# EasyEDA Pro project kuafu01_030内部老化方案.eprj, board PCB4 (continued)
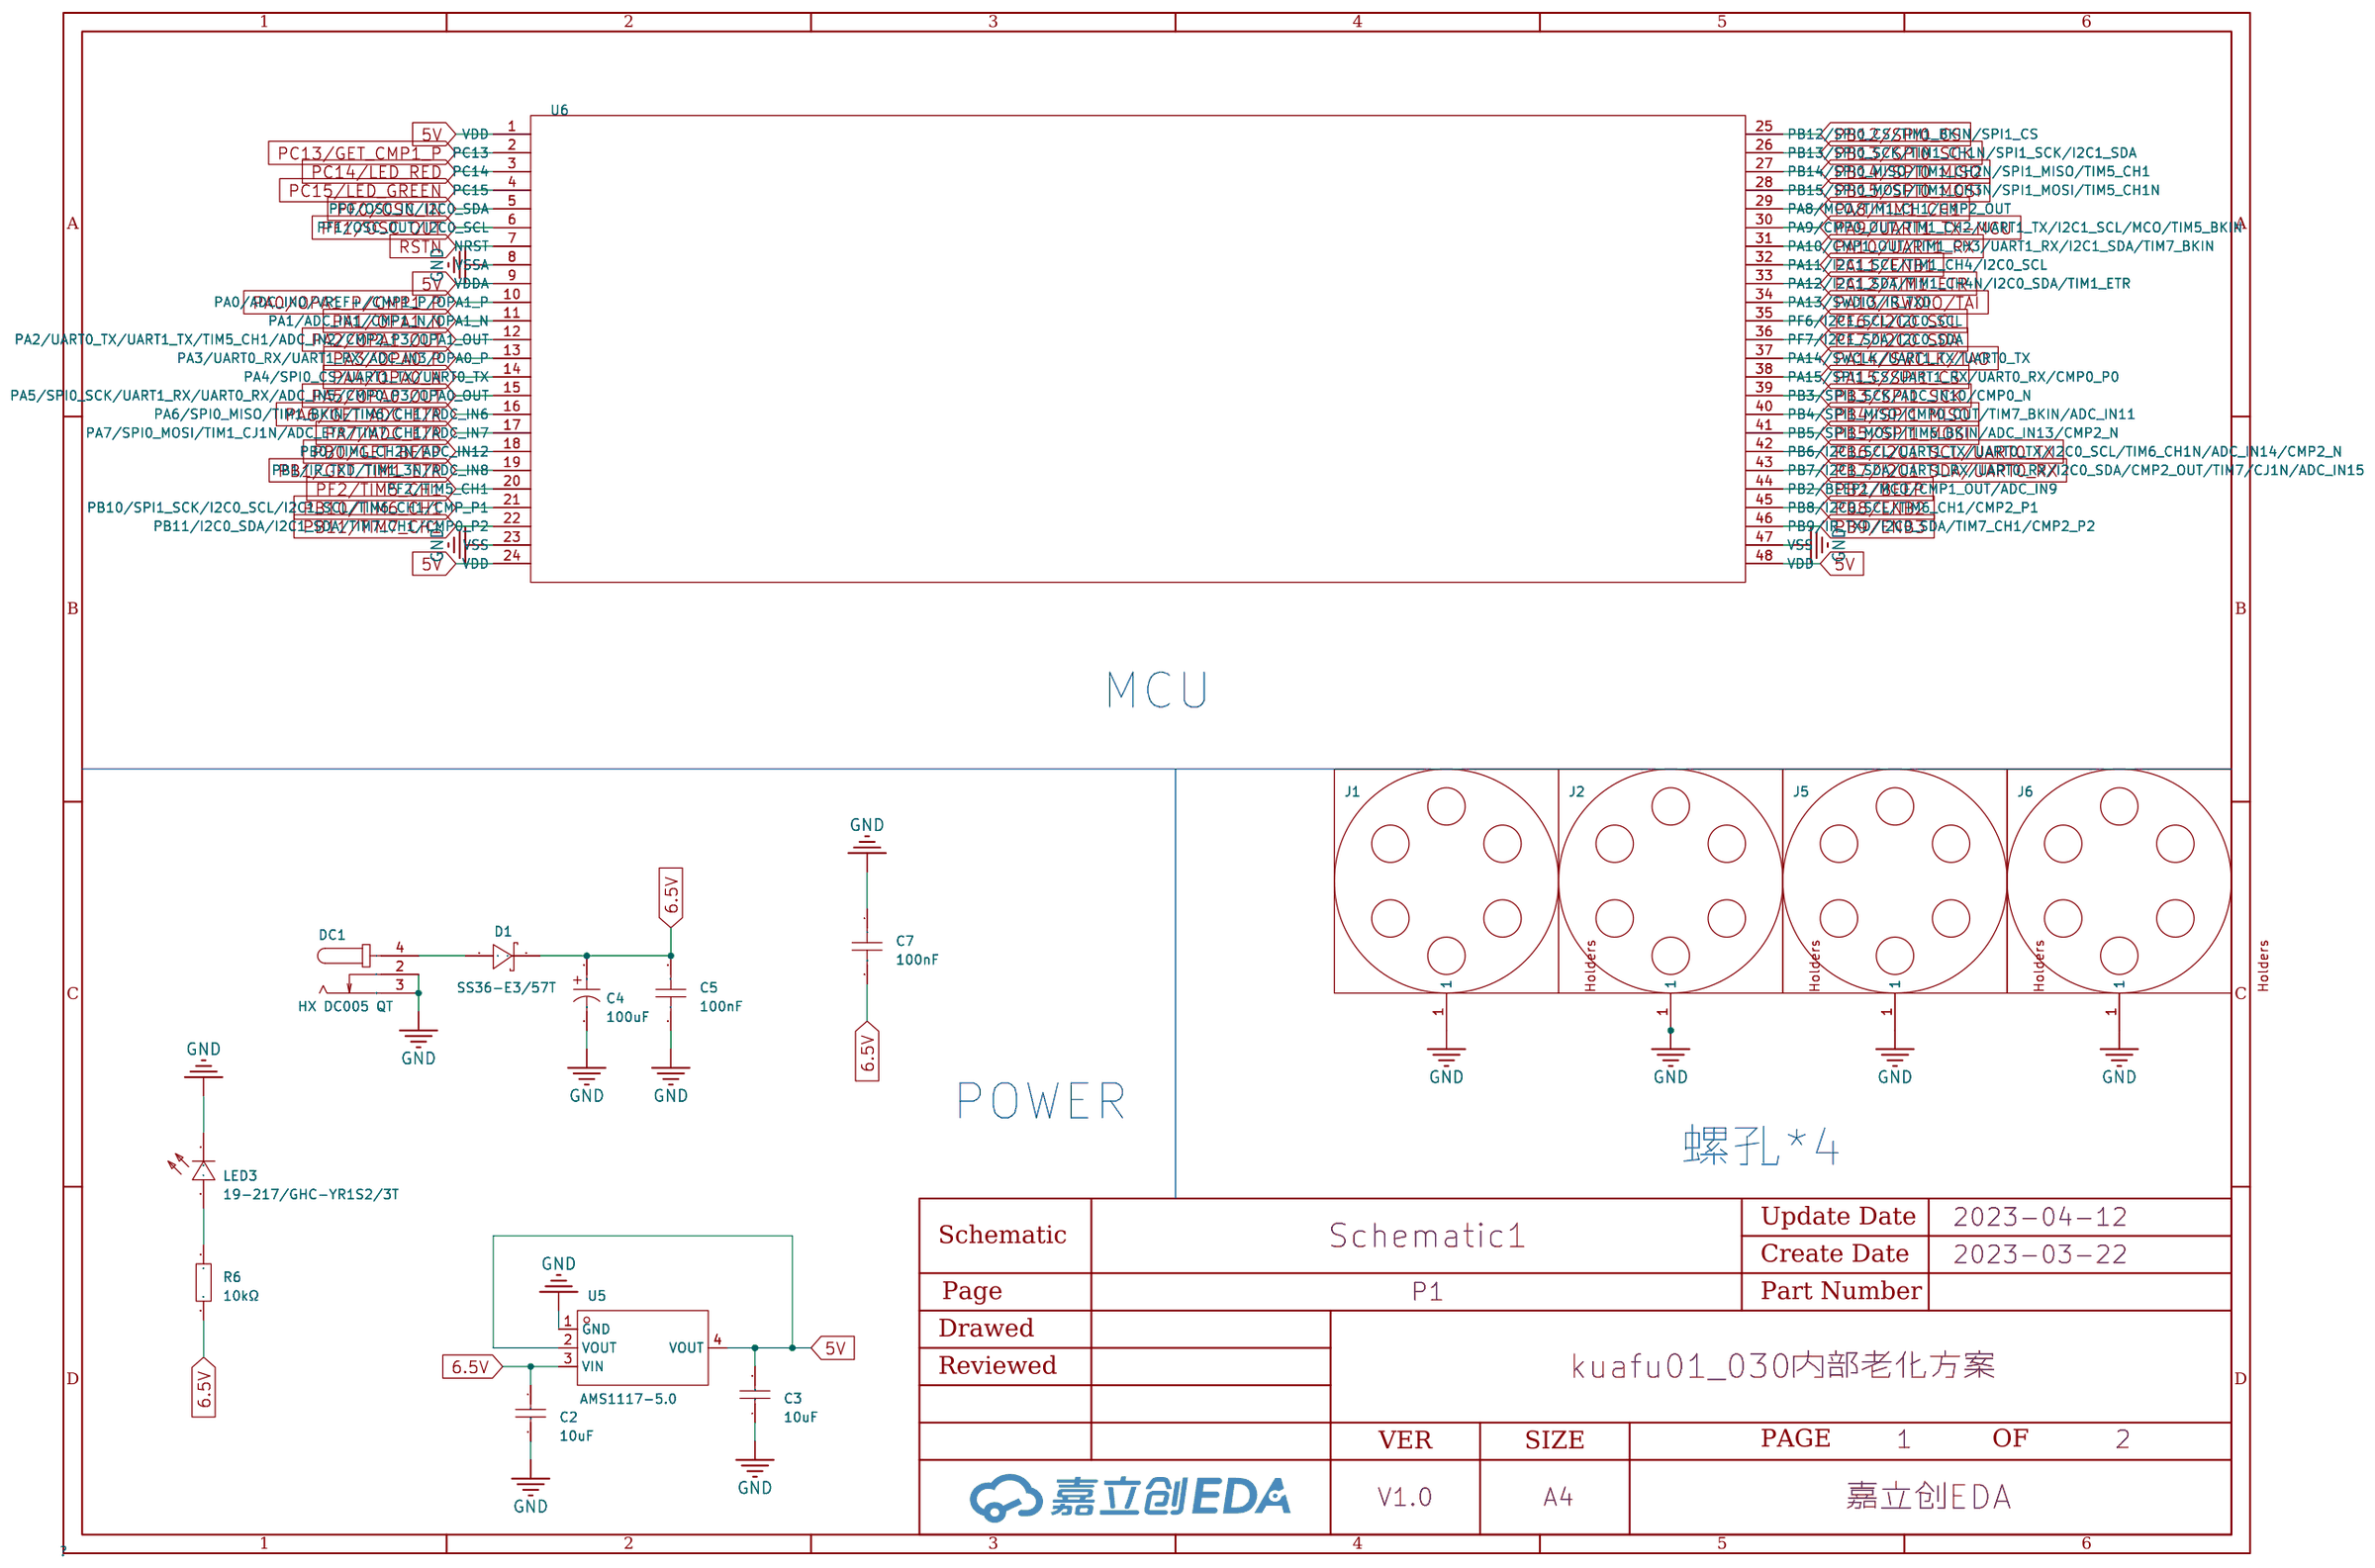
[diagram p0: P1]
## Routing (per net, layer and track width the routed paths; a pad name or vN(x,y) marks a point on that pad's centre or on a via; arc(x,y) is an arc through that point) (continued)
v1(170.94,68.83) v1(170.94,68.07) v1(170.94,41.15) v1(170.94,40.39) v1(170.94,39.62) v1(170.94,18.8) v1(170.94,18.03) v1(170.94,17.27) v1(171.7,345.95) v1(171.7,345.19) v1(171.7,344.42) v1(171.7,323.6) v1(171.7,322.83) v1(171.7,322.07) v1(171.7,295.15) v1(171.7,294.39) v1(171.7,293.62) v1(171.7,272.8) v1(171.7,272.03) v1(171.7,271.27) v1(171.7,244.35) v1(171.7,243.59) v1(171.7,242.82) v1(171.7,222) v1(171.7,221.23) v1(171.7,220.47) v1(171.7,193.55) v1(171.7,192.79) v1(171.7,192.02) v1(171.7,171.2) v1(171.7,170.43) v1(171.7,169.67) v1(171.7,142.75) v1(171.7,141.99) v1(171.7,141.22) v1(171.7,120.4) v1(171.7,119.63) v1(171.7,118.87) v1(171.7,91.95) v1(171.7,91.19) v1(171.7,90.42) v1(171.7,69.6) v1(171.7,68.83) v1(171.7,68.07) v1(171.7,41.15) v1(171.7,40.39) v1(171.7,39.62) v1(171.7,18.8) v1(171.7,18.03) v1(171.7,17.27) v1(173.23,338.84) v1(173.23,338.07) v1(173.23,337.31) v1(173.23,329.18) v1(173.23,328.42) v1(173.23,327.66) v1(173.23,288.04) v1(173.23,287.27) v1(173.23,286.51) v1(173.23,278.38) v1(173.23,277.62) v1(173.23,276.86) v1(173.23,237.24) v1(173.23,236.47) v1(173.23,235.71) v1(173.23,227.58) v1(173.23,226.82) v1(173.23,226.06) v1(173.23,186.44) v1(173.23,185.67) v1(173.23,184.91) v1(173.23,176.78) v1(173.23,176.02) v1(173.23,175.26) v1(173.23,135.64) v1(173.23,134.87) v1(173.23,134.11) v1(173.23,125.98) v1(173.23,125.22) v1(173.23,124.46) v1(173.23,84.84) v1(173.23,84.07) v1(173.23,83.31) v1(173.23,75.18) v1(173.23,74.42) v1(173.23,73.66) v1(173.23,34.04) v1(173.23,33.27) v1(173.23,32.51) v1(173.23,24.38) v1(173.23,23.62) v1(173.23,22.86) v1(173.99,338.84) v1(173.99,338.07) v1(173.99,337.31) v1(173.99,329.18) v1(173.99,328.42) v1(173.99,327.66) v1(173.99,288.04) v1(173.99,287.27) v1(173.99,286.51) v1(173.99,278.38) v1(173.99,277.62) v1(173.99,276.86) v1(173.99,237.24) v1(173.99,236.47) v1(173.99,235.71) v1(173.99,227.58) v1(173.99,226.82) v1(173.99,226.06) v1(173.99,186.44) v1(173.99,185.67) v1(173.99,184.91) v1(173.99,176.78) v1(173.99,176.02) v1(173.99,175.26) v1(173.99,135.64) v1(173.99,134.87) v1(173.99,134.11) v1(173.99,125.98) v1(173.99,125.22) v1(173.99,124.46) v1(173.99,84.84) v1(173.99,84.07) v1(173.99,83.31) v1(173.99,75.18) v1(173.99,74.42) v1(173.99,73.66) v1(173.99,34.04) v1(173.99,33.27) v1(173.99,32.51) v1(173.99,24.38) v1(173.99,23.62) v1(173.99,22.86) v1(174.75,338.84) v1(174.75,338.07) v1(174.75,337.31) v1(174.75,329.18) v1(174.75,328.42) v1(174.75,327.66) v1(174.75,288.04) v1(174.75,287.27) v1(174.75,286.51) v1(174.75,278.38) v1(174.75,277.62) v1(174.75,276.86) v1(174.75,237.24) v1(174.75,236.47) v1(174.75,235.71) v1(174.75,227.58) v1(174.75,226.82) v1(174.75,226.06) v1(174.75,186.44) v1(174.75,185.67) v1(174.75,184.91) v1(174.75,176.78) v1(174.75,176.02) v1(174.75,175.26) v1(174.75,135.64) v1(174.75,134.87) v1(174.75,134.11) v1(174.75,125.98) v1(174.75,125.22) v1(174.75,124.46) v1(174.75,84.84) v1(174.75,84.07) v1(174.75,83.31) v1(174.75,75.18) v1(174.75,74.42) v1(174.75,73.66) v1(174.75,34.04) v1(174.75,33.27) v1(174.75,32.51) v1(174.75,24.38) v1(174.75,23.62) v1(174.75,22.86) v1(179.83,338.84) v1(179.83,338.07) v1(179.83,337.31) v1(179.83,332.74) v1(179.83,331.98) v1(179.83,331.22) v1(179.83,325.12) v1(179.83,324.36) v1(179.83,323.6) v1(179.83,288.04) v1(179.83,287.27) v1(179.83,286.51) v1(179.83,281.94) v1(179.83,281.18) v1(179.83,280.42) v1(179.83,274.32) v1(179.83,273.56) v1(179.83,272.8) v1(179.83,237.24) v1(179.83,236.47) v1(179.83,235.71) v1(179.83,231.14) v1(179.83,230.38) v1(179.83,229.62) v1(179.83,223.52) v1(179.83,222.76) v1(179.83,222) v1(179.83,186.44) v1(179.83,185.67) v1(179.83,184.91) v1(179.83,180.34) v1(179.83,179.58) v1(179.83,178.82) v1(179.83,172.72) v1(179.83,171.96) v1(179.83,171.2) v1(179.83,135.64) v1(179.83,134.87) v1(179.83,134.11) v1(179.83,129.54) v1(179.83,128.78) v1(179.83,128.02) v1(179.83,121.92) v1(179.83,121.16) v1(179.83,120.4) v1(179.83,84.84) v1(179.83,84.07) v1(179.83,83.31) v1(179.83,78.74) v1(179.83,77.98) v1(179.83,77.22) v1(179.83,71.12) v1(179.83,70.36) v1(179.83,69.6) v1(179.83,34.04) v1(179.83,33.27) v1(179.83,32.51) v1(179.83,27.94) v1(179.83,27.18) v1(179.83,26.42) v1(179.83,20.32) v1(179.83,19.56) v1(179.83,18.8) v1(180.59,338.84) v1(180.59,338.07) v1(180.59,337.31) v1(180.59,332.74) v1(180.59,331.98) v1(180.59,331.22) v1(180.59,325.12) v1(180.59,324.36) v1(180.59,323.6) v1(180.59,288.04) v1(180.59,287.27) v1(180.59,286.51) v1(180.59,281.94) v1(180.59,281.18) v1(180.59,280.42) v1(180.59,274.32) v1(180.59,273.56) v1(180.59,272.8) v1(180.59,237.24) v1(180.59,236.47) v1(180.59,235.71) v1(180.59,231.14) v1(180.59,230.38) v1(180.59,229.62) v1(180.59,223.52) v1(180.59,222.76) v1(180.59,222) v1(180.59,186.44) v1(180.59,185.67) v1(180.59,184.91) v1(180.59,180.34) v1(180.59,179.58) v1(180.59,178.82) v1(180.59,172.72) v1(180.59,171.96) v1(180.59,171.2) v1(180.59,135.64) v1(180.59,134.87) v1(180.59,134.11) v1(180.59,129.54) v1(180.59,128.78) v1(180.59,128.02) v1(180.59,121.92) v1(180.59,121.16) v1(180.59,120.4) v1(180.59,84.84) v1(180.59,84.07) v1(180.59,83.31) v1(180.59,78.74) v1(180.59,77.98) v1(180.59,77.22) v1(180.59,71.12) v1(180.59,70.36) v1(180.59,69.6) v1(180.59,34.04) v1(180.59,33.27) v1(180.59,32.51) v1(180.59,27.94) v1(180.59,27.18) v1(180.59,26.42) v1(180.59,20.32) v1(180.59,19.56) v1(180.59,18.8) v1(181.36,338.84) v1(181.36,338.07) v1(181.36,337.31) v1(181.36,332.74) v1(181.36,331.98) v1(181.36,331.22) v1(181.36,325.12) v1(181.36,324.36) v1(181.36,323.6) v1(181.36,288.04) v1(181.36,287.27) v1(181.36,286.51) v1(181.36,281.94) v1(181.36,281.18) v1(181.36,280.42) v1(181.36,274.32) v1(181.36,273.56) v1(181.36,272.8) v1(181.36,237.24) v1(181.36,236.47) v1(181.36,235.71) v1(181.36,231.14) v1(181.36,230.38) v1(181.36,229.62) v1(181.36,223.52) v1(181.36,222.76) v1(181.36,222) v1(181.36,186.44) v1(181.36,185.67) v1(181.36,184.91) v1(181.36,180.34) v1(181.36,179.58) v1(181.36,178.82) v1(181.36,172.72) v1(181.36,171.96) v1(181.36,171.2) v1(181.36,135.64) v1(181.36,134.87) v1(181.36,134.11) v1(181.36,129.54) v1(181.36,128.78) v1(181.36,128.02) v1(181.36,121.92) v1(181.36,121.16) v1(181.36,120.4) v1(181.36,84.84) v1(181.36,84.07) v1(181.36,83.31) v1(181.36,78.74) v1(181.36,77.98) v1(181.36,77.22) v1(181.36,71.12) v1(181.36,70.36) v1(181.36,69.6) v1(181.36,34.04) v1(181.36,33.27) v1(181.36,32.51) v1(181.36,27.94) v1(181.36,27.18) v1(181.36,26.42) v1(181.36,20.32) v1(181.36,19.56) v1(181.36,18.8) v1(181.86,345.95) v1(181.86,345.19) v1(181.86,344.42) v1(181.86,295.15) v1(181.86,294.39) v1(181.86,293.62) v1(181.86,244.35) v1(181.86,243.59) v1(181.86,242.82) v1(181.86,193.55) v1(181.86,192.79) v1(181.86,192.02) v1(181.86,142.75) v1(181.86,141.99) v1(181.86,141.22) v1(181.86,91.95) v1(181.86,91.19) v1(181.86,90.42) v1(181.86,41.15) v1(181.86,40.39) v1(181.86,39.62) v1(182.63,345.95) v1(182.63,345.19) v1(182.63,344.42) v1(182.63,295.15) v1(182.63,294.39) v1(182.63,293.62) v1(182.63,244.35) v1(182.63,243.59) v1(182.63,242.82) v1(182.63,193.55) v1(182.63,192.79) v1(182.63,192.02) v1(182.63,142.75) v1(182.63,141.99) v1(182.63,141.22) v1(182.63,91.95) v1(182.63,91.19) v1(182.63,90.42) v1(182.63,41.15) v1(182.63,40.39) v1(182.63,39.62) v1(183.39,352.04) v1(183.39,351.28) v1(183.39,350.52) v1(183.39,345.95) v1(183.39,345.19) v1(183.39,344.42) v1(183.39,301.24) v1(183.39,300.48) v1(183.39,299.72) v1(183.39,295.15) v1(183.39,294.39) v1(183.39,293.62) v1(183.39,250.44) v1(183.39,249.68) v1(183.39,248.92) v1(183.39,244.35) v1(183.39,243.59) v1(183.39,242.82) v1(183.39,199.64) v1(183.39,198.88) v1(183.39,198.12) v1(183.39,193.55) v1(183.39,192.79) v1(183.39,192.02) v1(183.39,148.84) v1(183.39,148.08) v1(183.39,147.32) v1(183.39,142.75) v1(183.39,141.99) v1(183.39,141.22) v1(183.39,98.04) v1(183.39,97.28) v1(183.39,96.52) v1(183.39,91.95) v1(183.39,91.19) v1(183.39,90.42) v1(183.39,47.24) v1(183.39,46.48) v1(183.39,45.72) v1(183.39,41.15) v1(183.39,40.39) v1(183.39,39.62) v1(184.15,352.04) v1(184.15,351.28) v1(184.15,350.52) v1(184.15,301.24) v1(184.15,300.48) v1(184.15,299.72) v1(184.15,250.44) v1(184.15,249.68) v1(184.15,248.92) v1(184.15,199.64) v1(184.15,198.88) v1(184.15,198.12) v1(184.15,148.84) v1(184.15,148.08) v1(184.15,147.32) v1(184.15,98.04) v1(184.15,97.28) v1(184.15,96.52) v1(184.15,47.24) v1(184.15,46.48) v1(184.15,45.72) v1(184.91,352.04) v1(184.91,351.28) v1(184.91,350.52) v1(184.91,301.24) v1(184.91,300.48) v1(184.91,299.72) v1(184.91,250.44) v1(184.91,249.68) v1(184.91,248.92) v1(184.91,199.64) v1(184.91,198.88) v1(184.91,198.12) v1(184.91,148.84) v1(184.91,148.08) v1(184.91,147.32) v1(184.91,98.04) v1(184.91,97.28) v1(184.91,96.52) v1(184.91,47.24) v1(184.91,46.48) v1(184.91,45.72) v1(185.42,358.14) v1(185.42,357.38) v1(185.42,356.62) v1(185.42,319.02) v1(185.42,318.26) v1(185.42,317.5) v1(185.42,307.34) v1(185.42,306.58) v1(185.42,305.82) v1(185.42,268.22) v1(185.42,267.46) v1(185.42,266.7) v1(185.42,256.54) v1(185.42,255.78) v1(185.42,255.02) v1(185.42,217.42) v1(185.42,216.66) v1(185.42,215.9) v1(185.42,205.74) v1(185.42,204.98) v1(185.42,204.22) v1(185.42,166.62) v1(185.42,165.86) v1(185.42,165.1) v1(185.42,154.94) v1(185.42,154.18) v1(185.42,153.42) v1(185.42,115.82) v1(185.42,115.06) v1(185.42,114.3) v1(185.42,104.14) v1(185.42,103.38) v1(185.42,102.62) v1(185.42,65.02) v1(185.42,64.26) v1(185.42,63.5) v1(185.42,53.34) v1(185.42,52.58) v1(185.42,51.82) v1(185.42,14.22) v1(185.42,13.46) v1(185.42,12.7) v1(186.18,358.14) v1(186.18,357.38) v1(186.18,356.62) v1(186.18,319.02) v1(186.18,318.26) v1(186.18,317.5) v1(186.18,307.34) v1(186.18,306.58) v1(186.18,305.82) v1(186.18,268.22) v1(186.18,267.46) v1(186.18,266.7) v1(186.18,256.54) v1(186.18,255.78) v1(186.18,255.02) v1(186.18,217.42) v1(186.18,216.66) v1(186.18,215.9) v1(186.18,205.74) v1(186.18,204.98) v1(186.18,204.22) v1(186.18,166.62) v1(186.18,165.86) v1(186.18,165.1) v1(186.18,154.94) v1(186.18,154.18) v1(186.18,153.42) v1(186.18,115.82) v1(186.18,115.06) v1(186.18,114.3) v1(186.18,104.14) v1(186.18,103.38) v1(186.18,102.62) v1(186.18,65.02) v1(186.18,64.26) v1(186.18,63.5) v1(186.18,53.34) v1(186.18,52.58) v1(186.18,51.82) v1(186.18,14.22) v1(186.18,13.46) v1(186.18,12.7) v1(186.94,358.14) v1(186.94,357.38) v1(186.94,356.62) v1(186.94,319.02) v1(186.94,318.26) v1(186.94,317.5) v1(186.94,307.34) v1(186.94,306.58) v1(186.94,305.82) v1(186.94,268.22) v1(186.94,267.46) v1(186.94,266.7) v1(186.94,256.54) v1(186.94,255.78) v1(186.94,255.02) v1(186.94,217.42) v1(186.94,216.66) v1(186.94,215.9) v1(186.94,205.74) v1(186.94,204.98) v1(186.94,204.22) v1(186.94,166.62) v1(186.94,165.86) v1(186.94,165.1) v1(186.94,154.94) v1(186.94,154.18) v1(186.94,153.42) v1(186.94,115.82) v1(186.94,115.06) v1(186.94,114.3) v1(186.94,104.14) v1(186.94,103.38) v1(186.94,102.62) v1(186.94,65.02) v1(186.94,64.26) v1(186.94,63.5) v1(186.94,53.34) v1(186.94,52.58) v1(186.94,51.82) v1(186.94,14.22) v1(186.94,13.46) v1(186.94,12.7) v1(215.39,358.14) v1(215.39,357.38) v1(215.39,356.62) v1(215.39,319.02) v1(215.39,318.26) v1(215.39,317.5) v1(215.39,307.34) v1(215.39,306.58) v1(215.39,305.82) v1(215.39,268.22) v1(215.39,267.46) v1(215.39,266.7) v1(215.39,256.54) v1(215.39,255.78) v1(215.39,255.02) v1(215.39,217.42) v1(215.39,216.66) v1(215.39,215.9) v1(215.39,205.74) v1(215.39,204.98) v1(215.39,204.22) v1(215.39,166.62) v1(215.39,165.86) v1(215.39,165.1) v1(215.39,154.94) v1(215.39,154.18) v1(215.39,153.42) v1(215.39,115.82) v1(215.39,115.06) v1(215.39,114.3) v1(215.39,104.14) v1(215.39,103.38) v1(215.39,102.62) v1(215.39,65.02) v1(215.39,64.26) v1(215.39,63.5) v1(215.39,53.34) v1(215.39,52.58) v1(215.39,51.82) v1(215.39,14.22) v1(215.39,13.46) v1(215.39,12.7) v1(216.15,358.14) v1(216.15,357.38) v1(216.15,356.62) v1(216.15,319.02) v1(216.15,318.26) v1(216.15,317.5) v1(216.15,307.34) v1(216.15,306.58) v1(216.15,305.82) v1(216.15,268.22) v1(216.15,267.46) v1(216.15,266.7) v1(216.15,256.54) v1(216.15,255.78) v1(216.15,255.02) v1(216.15,217.42) v1(216.15,216.66) v1(216.15,215.9) v1(216.15,205.74) v1(216.15,204.98) v1(216.15,204.22) v1(216.15,166.62) v1(216.15,165.86) v1(216.15,165.1) v1(216.15,154.94) v1(216.15,154.18) v1(216.15,153.42) v1(216.15,115.82) v1(216.15,115.06) v1(216.15,114.3) v1(216.15,104.14) v1(216.15,103.38) v1(216.15,102.62) v1(216.15,65.02) v1(216.15,64.26) v1(216.15,63.5) v1(216.15,53.34) v1(216.15,52.58) v1(216.15,51.82) v1(216.15,14.22) v1(216.15,13.46) v1(216.15,12.7) v1(216.92,358.14) v1(216.92,357.38) v1(216.92,356.62) v1(216.92,319.02) v1(216.92,318.26) v1(216.92,317.5) v1(216.92,307.34) v1(216.92,306.58) v1(216.92,305.82) v1(216.92,268.22) v1(216.92,267.46) v1(216.92,266.7) v1(216.92,256.54) v1(216.92,255.78) v1(216.92,255.02) v1(216.92,217.42) v1(216.92,216.66) v1(216.92,215.9) v1(216.92,205.74) v1(216.92,204.98) v1(216.92,204.22) v1(216.92,166.62) v1(216.92,165.86) v1(216.92,165.1) v1(216.92,154.94) v1(216.92,154.18) v1(216.92,153.42) v1(216.92,115.82) v1(216.92,115.06) v1(216.92,114.3) v1(216.92,104.14) v1(216.92,103.38) v1(216.92,102.62) v1(216.92,65.02) v1(216.92,64.26) v1(216.92,63.5) v1(216.92,53.34) v1(216.92,52.58) v1(216.92,51.82) v1(216.92,14.22) v1(216.92,13.46) v1(216.92,12.7) v1(217.93,352.04) v1(217.93,351.28) v1(217.93,350.52) v1(217.93,301.24) v1(217.93,300.48) v1(217.93,299.72) v1(217.93,250.44) v1(217.93,249.68) v1(217.93,248.92) v1(217.93,199.64) v1(217.93,198.88) v1(217.93,198.12) v1(217.93,148.84) v1(217.93,148.08) v1(217.93,147.32) v1(217.93,98.04) v1(217.93,97.28) v1(217.93,96.52) v1(217.93,47.24) v1(217.93,46.48) v1(217.93,45.72) v1(218.69,352.04) v1(218.69,351.28) v1(218.69,350.52) v1(218.69,301.24) v1(218.69,300.48) v1(218.69,299.72) v1(218.69,250.44) v1(218.69,249.68) v1(218.69,248.92) v1(218.69,199.64) v1(218.69,198.88) v1(218.69,198.12) v1(218.69,148.84) v1(218.69,148.08) v1(218.69,147.32) v1(218.69,98.04) v1(218.69,97.28) v1(218.69,96.52) v1(218.69,47.24) v1(218.69,46.48) v1(218.69,45.72) v1(219.46,352.04) v1(219.46,351.28) v1(219.46,350.52) v1(219.46,301.24) v1(219.46,300.48) v1(219.46,299.72) v1(219.46,250.44) v1(219.46,249.68) v1(219.46,248.92) v1(219.46,199.64) v1(219.46,198.88) v1(219.46,198.12) v1(219.46,148.84) v1(219.46,148.08) v1(219.46,147.32) v1(219.46,98.04) v1(219.46,97.28) v1(219.46,96.52) v1(219.46,47.24) v1(219.46,46.48) v1(219.46,45.72) v1(220.98,345.95) v1(220.98,345.19) v1(220.98,344.42) v1(220.98,323.6) v1(220.98,322.83) v1(220.98,322.07) v1(220.98,295.15) v1(220.98,294.39) v1(220.98,293.62) v1(220.98,272.8) v1(220.98,272.03) v1(220.98,271.27) v1(220.98,244.35) v1(220.98,243.59) v1(220.98,242.82) v1(220.98,222) v1(220.98,221.23) v1(220.98,220.47) v1(220.98,193.55) v1(220.98,192.79) v1(220.98,192.02) v1(220.98,171.2) v1(220.98,170.43) v1(220.98,169.67) v1(220.98,142.75) v1(220.98,141.99) v1(220.98,141.22) v1(220.98,120.4) v1(220.98,119.63) v1(220.98,118.87) v1(220.98,91.95) v1(220.98,91.19) v1(220.98,90.42) v1(220.98,69.6) v1(220.98,68.83) v1(220.98,68.07) v1(220.98,41.15) v1(220.98,40.39) v1(220.98,39.62) v1(220.98,18.8) v1(220.98,18.03) v1(220.98,17.27) v1(221.74,345.95) v1(221.74,345.19) v1(221.74,344.42) v1(221.74,323.6) v1(221.74,322.83) v1(221.74,322.07) v1(221.74,295.15) v1(221.74,294.39) v1(221.74,293.62) v1(221.74,272.8) v1(221.74,272.03) v1(221.74,271.27) v1(221.74,244.35) v1(221.74,243.59) v1(221.74,242.82) v1(221.74,222) v1(221.74,221.23) v1(221.74,220.47) v1(221.74,193.55) v1(221.74,192.79) v1(221.74,192.02) v1(221.74,171.2) v1(221.74,170.43) v1(221.74,169.67) v1(221.74,142.75) v1(221.74,141.99) v1(221.74,141.22) v1(221.74,120.4) v1(221.74,119.63) v1(221.74,118.87) v1(221.74,91.95) v1(221.74,91.19) v1(221.74,90.42) v1(221.74,69.6) v1(221.74,68.83) v1(221.74,68.07) v1(221.74,41.15) v1(221.74,40.39) v1(221.74,39.62) v1(221.74,18.8) v1(221.74,18.03) v1(221.74,17.27) v1(222.5,345.95) v1(222.5,345.19) v1(222.5,344.42) v1(222.5,323.6) v1(222.5,322.83) v1(222.5,322.07) v1(222.5,295.15) v1(222.5,294.39) v1(222.5,293.62) v1(222.5,272.8) v1(222.5,272.03) v1(222.5,271.27) v1(222.5,244.35) v1(222.5,243.59) v1(222.5,242.82) v1(222.5,222) v1(222.5,221.23) v1(222.5,220.47) v1(222.5,193.55) v1(222.5,192.79) v1(222.5,192.02) v1(222.5,171.2) v1(222.5,170.43) v1(222.5,169.67) v1(222.5,142.75) v1(222.5,141.99) v1(222.5,141.22) v1(222.5,120.4) v1(222.5,119.63) v1(222.5,118.87) v1(222.5,91.95) v1(222.5,91.19) v1(222.5,90.42) v1(222.5,69.6) v1(222.5,68.83) v1(222.5,68.07) v1(222.5,41.15) v1(222.5,40.39) v1(222.5,39.62) v1(222.5,18.8) v1(222.5,18.03) v1(222.5,17.27) v1(224.03,338.84) v1(224.03,338.07) v1(224.03,337.31) v1(224.03,329.18) v1(224.03,328.42) v1(224.03,327.66) v1(224.03,288.04) v1(224.03,287.27) v1(224.03,286.51) v1(224.03,278.38) v1(224.03,277.62) v1(224.03,276.86) v1(224.03,237.24) v1(224.03,236.47) v1(224.03,235.71) v1(224.03,227.58) v1(224.03,226.82) v1(224.03,226.06) v1(224.03,186.44) v1(224.03,185.67) v1(224.03,184.91) v1(224.03,176.78) v1(224.03,176.02) v1(224.03,175.26) v1(224.03,135.64) v1(224.03,134.87) v1(224.03,134.11) v1(224.03,125.98) v1(224.03,125.22) v1(224.03,124.46) v1(224.03,84.84) v1(224.03,84.07) v1(224.03,83.31) v1(224.03,75.18) v1(224.03,74.42) v1(224.03,73.66) v1(224.03,34.04) v1(224.03,33.27) v1(224.03,32.51) v1(224.03,24.38) v1(224.03,23.62) v1(224.03,22.86) v1(224.79,338.84) v1(224.79,338.07) v1(224.79,337.31) v1(224.79,329.18) v1(224.79,328.42) v1(224.79,327.66) v1(224.79,288.04) v1(224.79,287.27) v1(224.79,286.51) v1(224.79,278.38) v1(224.79,277.62) v1(224.79,276.86) v1(224.79,237.24) v1(224.79,236.47) v1(224.79,235.71) v1(224.79,227.58) v1(224.79,226.82) v1(224.79,226.06) v1(224.79,186.44) v1(224.79,185.67) v1(224.79,184.91) v1(224.79,176.78) v1(224.79,176.02) v1(224.79,175.26) v1(224.79,135.64) v1(224.79,134.87) v1(224.79,134.11) v1(224.79,125.98) v1(224.79,125.22) v1(224.79,124.46) v1(224.79,84.84) v1(224.79,84.07) v1(224.79,83.31) v1(224.79,75.18) v1(224.79,74.42) v1(224.79,73.66) v1(224.79,34.04) v1(224.79,33.27) v1(224.79,32.51) v1(224.79,24.38) v1(224.79,23.62) v1(224.79,22.86) v1(225.55,338.84) v1(225.55,338.07) v1(225.55,337.31) v1(225.55,329.18) v1(225.55,328.42) v1(225.55,327.66) v1(225.55,288.04) v1(225.55,287.27) v1(225.55,286.51) v1(225.55,278.38) v1(225.55,277.62) v1(225.55,276.86) v1(225.55,237.24) v1(225.55,236.47) v1(225.55,235.71) v1(225.55,227.58) v1(225.55,226.82) v1(225.55,226.06) v1(225.55,186.44) v1(225.55,185.67) v1(225.55,184.91) v1(225.55,176.78) v1(225.55,176.02) v1(225.55,175.26) v1(225.55,135.64) v1(225.55,134.87) v1(225.55,134.11) v1(225.55,125.98) v1(225.55,125.22) v1(225.55,124.46) v1(225.55,84.84) v1(225.55,84.07) v1(225.55,83.31) v1(225.55,75.18) v1(225.55,74.42) v1(225.55,73.66) v1(225.55,34.04) v1(225.55,33.27) v1(225.55,32.51) v1(225.55,24.38) v1(225.55,23.62) v1(225.55,22.86) v1(230.63,338.84) v1(230.63,338.07) v1(230.63,337.31) v1(230.63,332.74) v1(230.63,331.98) v1(230.63,331.22) v1(230.63,325.12) v1(230.63,324.36) v1(230.63,323.6) v1(230.63,288.04) v1(230.63,287.27) v1(230.63,286.51) v1(230.63,281.94) v1(230.63,281.18) v1(230.63,280.42) v1(230.63,274.32) v1(230.63,273.56) v1(230.63,272.8) v1(230.63,237.24) v1(230.63,236.47) v1(230.63,235.71) v1(230.63,231.14) v1(230.63,230.38) v1(230.63,229.62) v1(230.63,223.52) v1(230.63,222.76) v1(230.63,222) v1(230.63,186.44) v1(230.63,185.67) v1(230.63,184.91) v1(230.63,180.34) v1(230.63,179.58) v1(230.63,178.82) v1(230.63,172.72) v1(230.63,171.96) v1(230.63,171.2) v1(230.63,135.64) v1(230.63,134.87) v1(230.63,134.11) v1(230.63,129.54) v1(230.63,128.78) v1(230.63,128.02) v1(230.63,121.92) v1(230.63,121.16) v1(230.63,120.4) v1(230.63,84.84) v1(230.63,84.07) v1(230.63,83.31) v1(230.63,78.74) v1(230.63,77.98) v1(230.63,77.22) v1(230.63,71.12) v1(230.63,70.36) v1(230.63,69.6) v1(230.63,34.04) v1(230.63,33.27) v1(230.63,32.51) v1(230.63,27.94) v1(230.63,27.18) v1(230.63,26.42) v1(230.63,20.32) v1(230.63,19.56) v1(230.63,18.8) v1(231.39,338.84) v1(231.39,338.07) v1(231.39,337.31) v1(231.39,332.74) v1(231.39,331.98) v1(231.39,331.22) v1(231.39,325.12) v1(231.39,324.36) v1(231.39,323.6) v1(231.39,288.04) v1(231.39,287.27) v1(231.39,286.51) v1(231.39,281.94) v1(231.39,281.18) v1(231.39,280.42) v1(231.39,274.32) v1(231.39,273.56) v1(231.39,272.8) 